# EasyEDA Pro project Foc驱动板.eprj, board PCB1
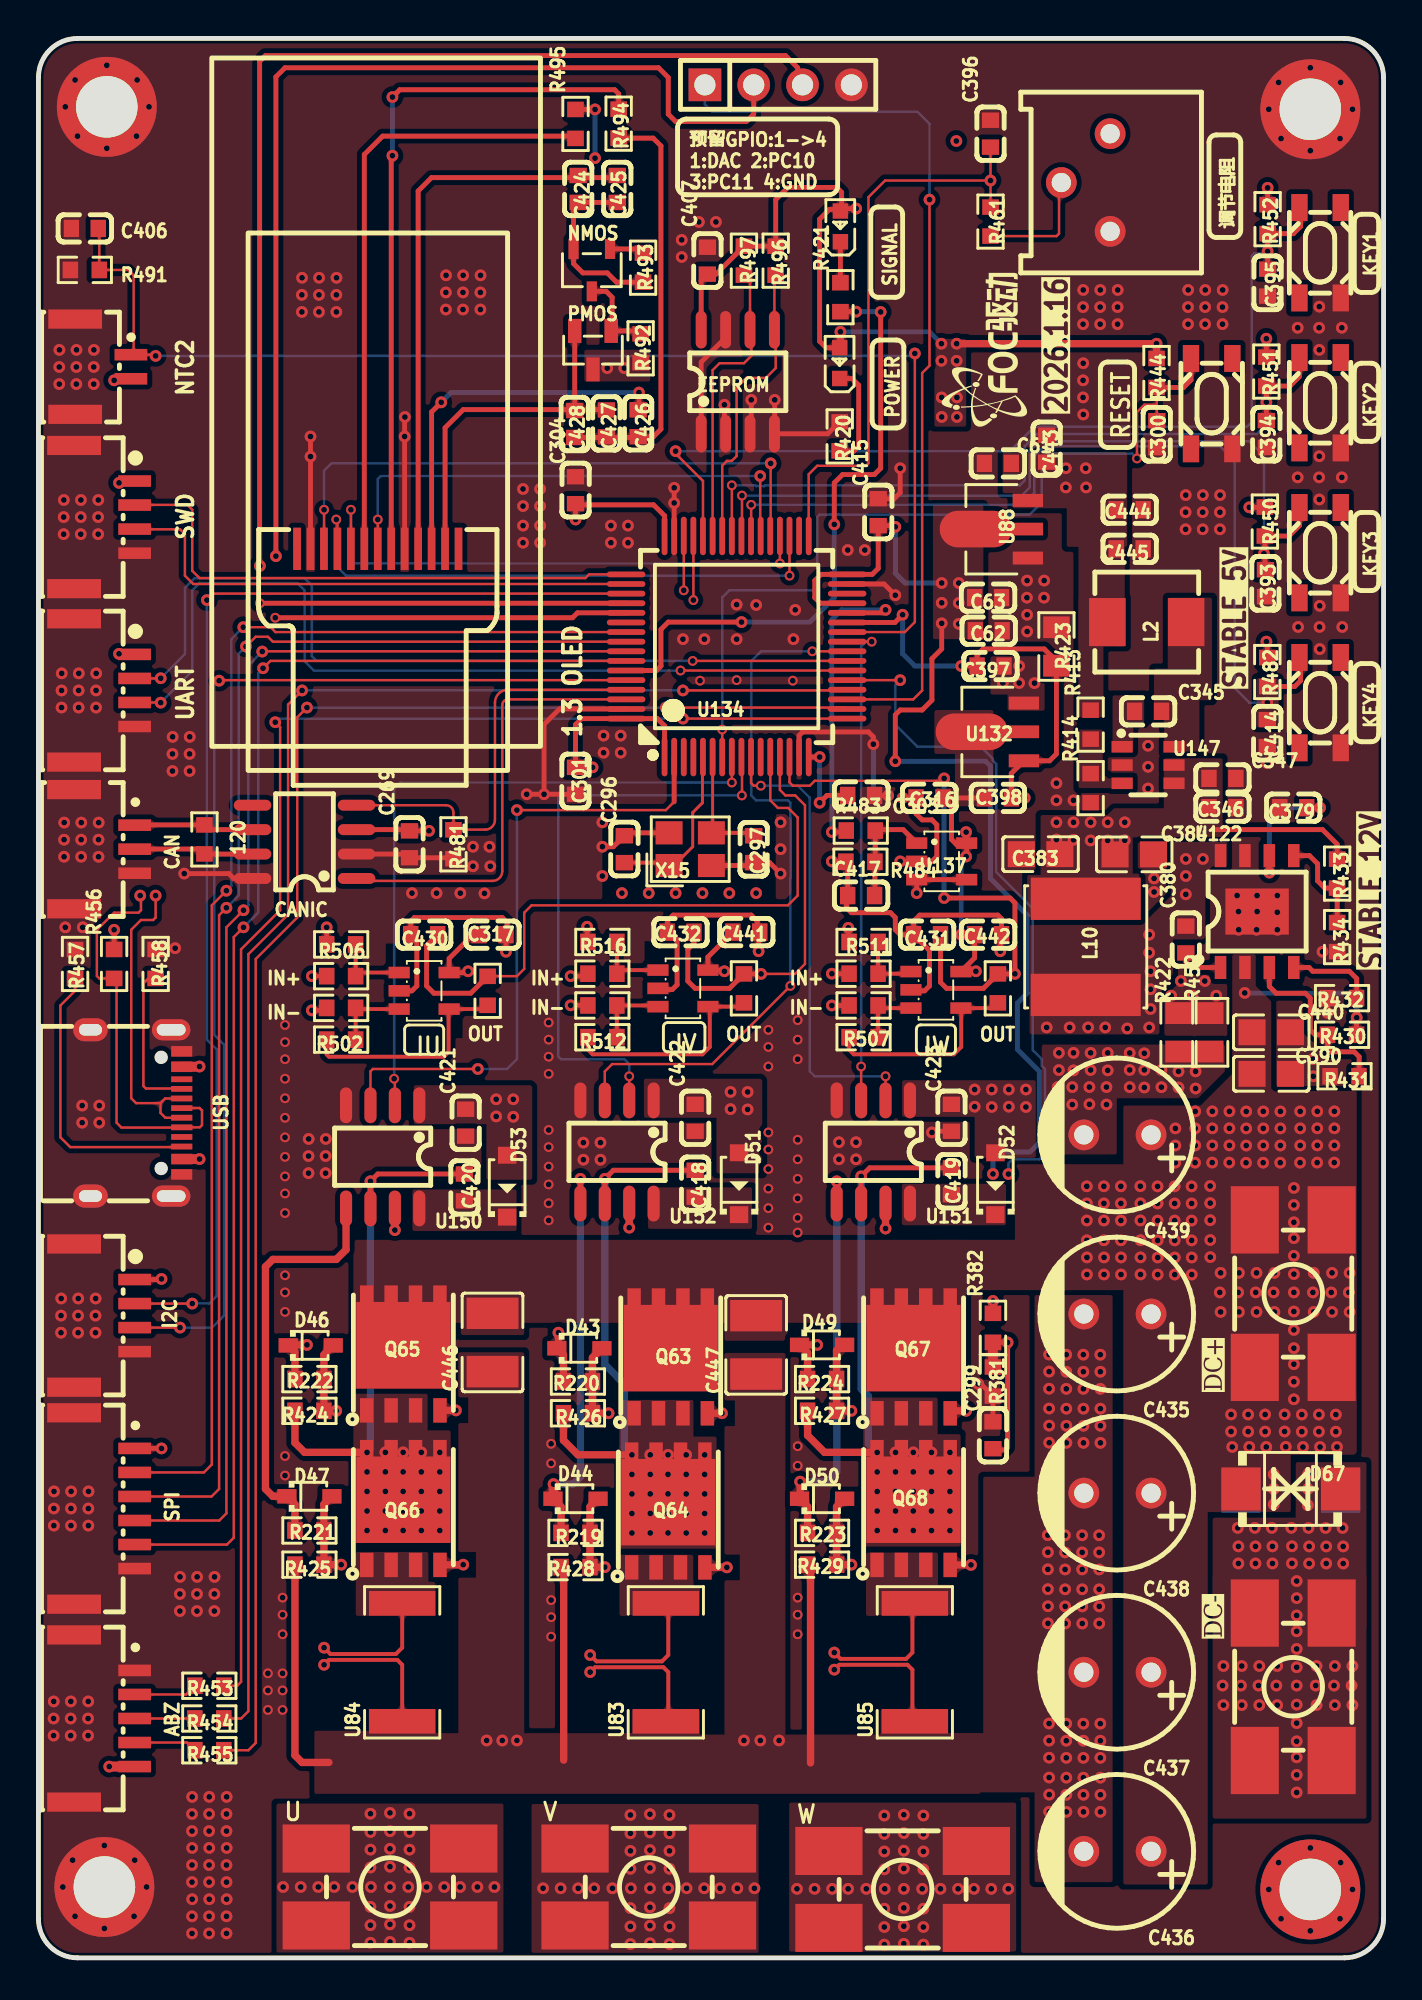
[diagram p8: board, top side]
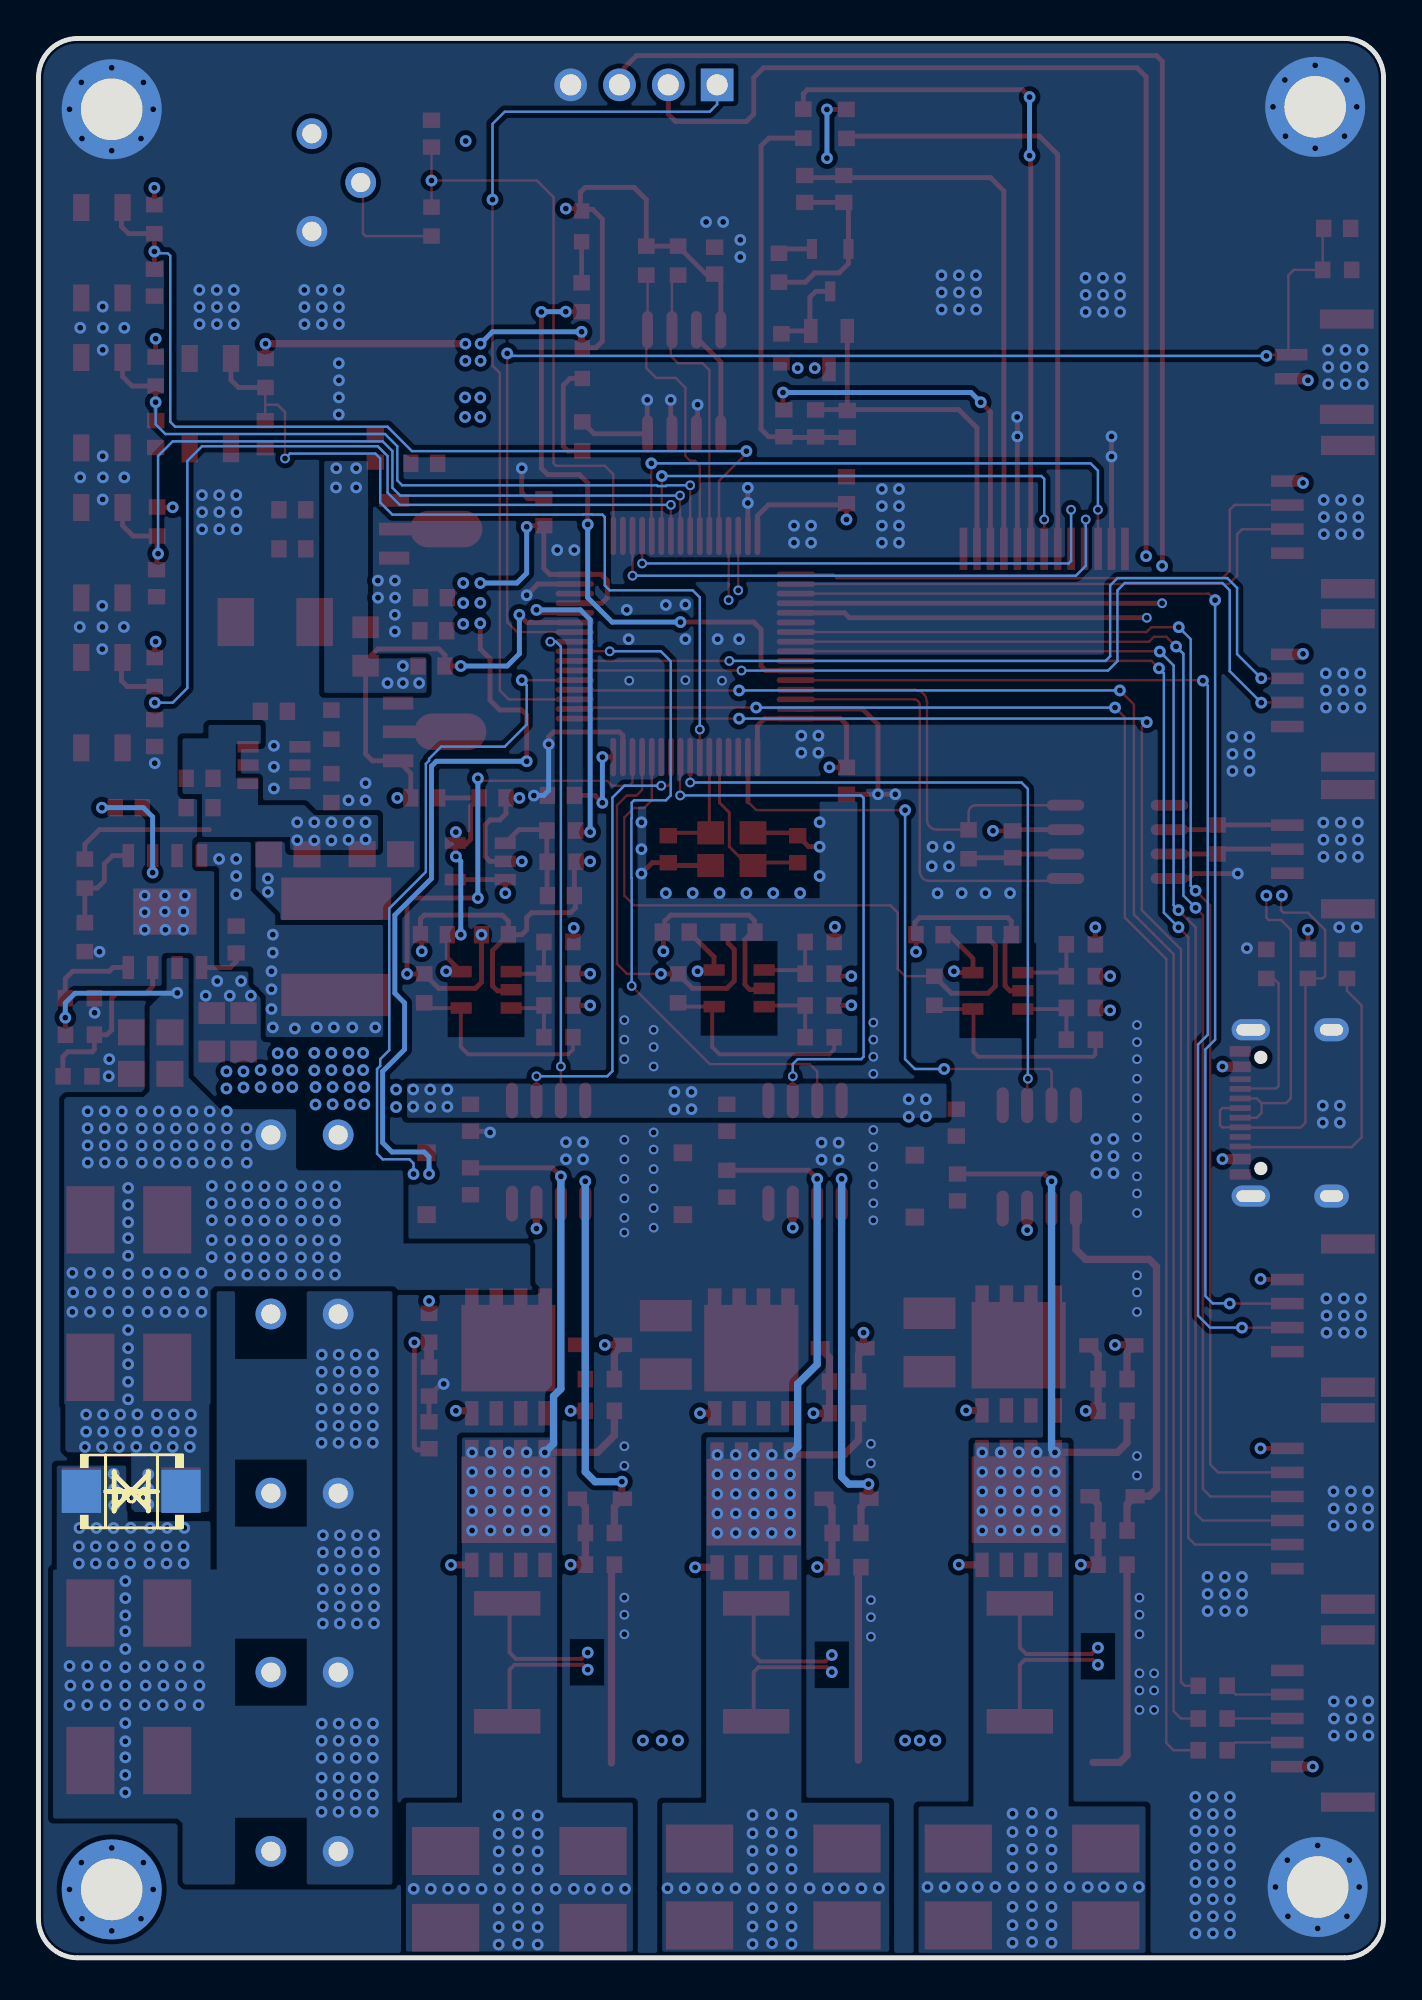
[diagram p9: board, bottom side, seen from below]

Outline 69.98 x 99.82 mm; copper layers: Top Layer, Inner1, Inner2, Bottom Layer. Coordinates in mm from the lower left corner of the outline.
Outline path: 0,97.79 0,2.03 arc(0.6,0.6) 2.03,0 67.94,0 arc(69.38,0.6) 69.98,2.03 69.98,97.79 arc(69.38,99.23) 67.94,99.82 2.03,99.82 arc(0.6,99.23) 0,97.79
Stack: Top Layer 0.035mm 外层铜厚1oz / Dielectric1 0.2104mm 7628 RC49% 8.6mil / Inner1 0.0152mm 内层铜厚 / Dielectric2 1.065mm 1.1mm H/HOZ Copper / Inner2 0.0152mm 内层铜厚 / Dielectric3 0.2104mm 7628 RC49% 8.6mil / Bottom Layer 0.035mm 外层铜厚1oz

## Design rules (mm)
template: 自定义配置
spacing copperThickness1oz (default): track to track 0.102, other pairs 0.152 to 0.3
spacing copperThickness2oz: track to track 0.203, other pairs 0.152 to 0.3
track width copperThickness1oz (default): min 0.127, default 0.254, max 2.54
track width copperThickness2oz: min 0.203, default 0.254, max 2.54
differential pair differentialPair (default): width min 0.127, default 0.254, max 2.54; gap min 0.152, default 0.152
via viaSize (default): diameter min 0.5, default 0.61, max 10; hole min 0.3, default 0.305, max 6.3

## Placement (name value [footprint] x y rotation side)
1.3 OLED  -  [OLED-SMD_ST7735S]  17.65 73.28 0 top
120  -  [R0603]  8.64 58.17 270 top
ABZ  -  [CONN-SMD_5P-P1.25_XUNPU_WAFER-GH1.25-5PWB]  3.43 12.45 270 top
C61  100nF  [C0603]  49.91 77.72 180 top
C62  10uF  [C0603]  49.44 69.02 0 top
C63  100nF  [C0603]  49.4 70.74 0 top
C269  100nF  [C0603]  19.3 57.91 270 top
C296  22pf  [C0603]  30.48 57.66 270 top
C297  22pf  [C0603]  37.21 57.66 90 top
C299  100nF  [C0603]  49.66 27.18 270 top
C300  100nF  [C0603]  58.18 79.24 90 top
C301  100nF  [C0603]  27.94 61.21 90 top
C303  100nF  [C0603]  42.8 60.45 180 top
C304  100nF  [C0603]  27.94 76.33 270 top
C316  100nF  [C0603]  46.35 60.33 0 top
C317  100nF  [C0603]  23.62 53.21 180 top
C345  100nF  [C0603]  57.73 64.83 180 top
C346  100nF  [C0603]  61.59 59.82 0 top
C347  22uF  [C0603]  61.59 61.34 180 top
C379  1uF  [C0603]  65.28 59.82 0 top
C380  100nF  [C0603]  59.69 52.96 270 top
C383  22uF  [C0805]  52.13 57.4 0 top
C384  22uF  [C0805]  57.01 57.39 180 top
C390  22uF  [C0805]  64.13 45.97 180 top
C393  100nF  [C0603]  63.83 71.49 90 top
C394  100nF  [C0603]  63.88 79.25 90 top
C395  100nF  [C0603]  63.95 87.12 90 top
C396  1nF  [C0603]  49.53 94.87 270 top
C397  100nF  [C0603]  49.53 67.18 180 top
C398  10uF  [C0603]  49.91 60.33 0 top
C406  100nF  [C0603]  2.41 89.94 0 top
C407  100nF  [C0603]  34.8 88.27 270 top
C414  100nF  [C0603]  63.93 63.7 90 top
C415  100nF  [C0603]  43.69 75.18 270 top
C417  10nF  [C0603]  42.8 55.24 0 top
C418  1uf  [C0603]  34.16 40.26 90 top
C419  1uf  [C0603]  47.5 40.39 90 top
C420  1uf  [C0603]  22.16 40.07 90 top
C421  4.7uF  [C0603]  22.22 43.43 270 top
C422  4.7uF  [C0603]  34.16 43.69 270 top
C423  4.7uF  [C0603]  47.5 43.69 270 top
C424  0.1uf  [C0603]  28.08 91.99 90 top
C425  4.7uf  [C0603]  30.11 91.99 90 top
C426  2.2uf  [C0603]  31.2 79.81 90 top
C427  4.7uf  [C0603]  29.55 79.8 90 top
C428  0.1uf  [C0603]  27.9 79.77 90 top
C430  1nF  [C0603]  20.07 53.21 0 top
C431  1nF  [C0603]  46.23 53.21 0 top
C432  1nF  [C0603]  33.4 53.34 0 top
C435  100uF  [CAP-TH_BD8.0-P3.50-D0.5-FD]  56.13 33.48 180 top
C436  100uF  [CAP-TH_BD8.0-P3.50-D0.5-FD]  56.13 5.54 180 top
C437  100uF  [CAP-TH_BD8.0-P3.50-D0.5-FD]  56.13 14.85 180 top
C438  100uF  [CAP-TH_BD8.0-P3.50-D0.5-FD]  56.13 24.17 180 top
C439  100uF  [CAP-TH_BD8.0-P3.50-D0.5-FD]  56.13 42.8 180 top
C440  4.7uF  [C0805]  64.13 48.13 180 top
C441  100nF  [C0603]  36.82 53.34 180 top
C442  100nF  [C0603]  49.4 53.21 180 top
C443  22uF  [C0603]  52.45 78.49 90 top
C444  22uF  [C0603]  56.77 75.31 0 top
C445  100nF  [C0603]  56.77 73.28 0 top
C446  100uF  [C1210]  23.62 32 90 top
C447  100uF  [C1210]  37.34 31.88 90 top
CAN  -  [CONN-TH_3P-P1.25_GH1.25]  3.43 57.66 270 top
CANIC  -  [SOIC-8_L5.0-W4.0-P1.27-LS6.0-BL]  13.84 58.04 90 top
D43  BAT43WS-7-F  [SOD-323_L1.8-W1.3-LS2.5-RD]  28.14 31.7 0 top
D44  BAT43WS-7-F  [SOD-323_L1.8-W1.3-LS2.5-RD]  27.94 23.88 0 top
D46  BAT43WS-7-F  [SOD-323_L1.8-W1.3-LS2.5-RD]  14.16 31.85 0 top
D47  BAT43WS-7-F  [SOD-323_L1.8-W1.3-LS2.5-RD]  14.1 24 0 top
D49  BAT43WS-7-F  [SOD-323_L1.8-W1.3-LS2.5-RD]  40.77 31.88 0 top
D50  BAT43WS-7-F  [SOD-323_L1.8-W1.3-LS2.5-RD]  40.77 23.88 0 top
D51  1N4148W  [SOD-123_L2.7-W1.6-LS3.7-FD]  36.45 40.26 270 top
D52  1N4148W  [SOD-123_L2.7-W1.6-LS3.7-FD]  49.78 40.26 270 top
D53  1N4148W  [SOD-123_L2.7-W1.6-LS3.7-FD]  24.38 40.13 270 top
D66  SMBJ48CA  [SMB_L4.6-W3.6-LS5.4-BI]  65.15 24.26 180 bottom
D67  SMBJ48CA  [SMB_L4.6-W3.6-LS5.4-BI]  65.15 24.38 180 top
DC+  -  [CONN-SMD_TS34031]  65.28 34.54 90 top
DC-  -  [CONN-SMD_TS34031]  65.28 14.1 90 top
EEPROM  -  [SOIC-8_L5.0-W4.0-P1.27-LS6.0-BL]  36.38 81.97 0 top
I2C  -  [CONN-SMD_4P-P1.25_XUNPU_WAFER-GH1.25-4PWB]  3.43 33.4 270 top
IN+  -  [R0603]  15.75 51.05 180 top
IN+#2  -  [R0603]  42.93 51.18 180 top
IN+#3  -  [R0603]  29.34 51.18 180 top
IN-  -  [R0603]  15.75 49.4 180 top
IN-#2  -  [R0603]  42.93 49.53 180 top
IN-#3  -  [R0603]  29.34 49.53 180 top
IU  -  [SOT-23-5_L3.0-W1.7-P0.95-LS2.8-BR]  20.07 50.29 180 top
IV  -  [SOT-23-5_L3.0-W1.7-P0.95-LS2.8-BR]  33.53 50.42 180 top
IW  -  [SOT-23-5_L3.0-W1.7-P0.95-LS2.8-BR]  46.69 50.34 180 top
KEY1  TS-1145A-B-A  [SW-SMD_4P-L4.2-W3.2-P2.15-LS5.2]  66.67 88.68 180 top
KEY2  TS-1145A-B-A  [SW-SMD_4P-L4.2-W3.2-P2.15-LS5.2]  66.67 80.88 180 top
KEY3  TS-1145A-B-A  [SW-SMD_4P-L4.2-W3.2-P2.15-LS5.2]  66.67 73.08 180 top
KEY4  TS-1145A-B-A  [SW-SMD_4P-L4.2-W3.2-P2.15-LS5.2]  66.67 65.28 180 top
L2  10uH  [IND-SMD_L5.4-W5.2_FXL0530]  57.66 69.47 180 top
L10  18uH  [IND-SMD_L6.0-W6.0]  54.48 52.58 90 top
NMOS  -  [SOT-23-3_L3.0-W1.7-P0.95-LS2.9-BR]  28.79 87.77 90 top
NOREF  -  [Pad_e217]  3.56 96.27 0 top
NOREF#2  -  [Pad_e226]  3.43 3.68 0 top
NOREF#3  -  [Pad_e207]  66.17 96.14 0 top
NOREF#4  -  [Pad_e235]  66.17 3.56 0 top
NTC2  -  [CONN-TH_2P-P1.25_XUNPU_WAFER-GH1.25-2PWB]  3.36 82.75 270 top
OUT  -  [R0603]  23.37 50.29 270 top
OUT#2  -  [R0603]  49.91 50.42 270 top
OUT#3  -  [R0603]  36.7 50.42 270 top
PMOS  -  [SOT-23-3_L2.9-W1.3-P1.90-LS2.4-BR]  28.85 83.61 90 top
POWER  -  [LED0603-RD]  41.68 82.94 90 top
Q63  CSD18540Q5B  [VSON-CLIP-8_L5.0-W6.0-P1.27-BL]  32.89 31.32 0 top
Q64  CSD18540Q5B  [VSON-CLIP-8_L5.0-W6.0-P1.27-BL]  32.77 23.31 0 top
Q65  CSD18540Q5B  [VSON-CLIP-8_L5.0-W6.0-P1.27-BL]  18.98 31.47 0 top
Q66  CSD18540Q5B  [VSON-CLIP-8_L5.0-W6.0-P1.27-BL]  18.98 23.44 0 top
Q67  CSD18540Q5B  [VSON-CLIP-8_L5.0-W6.0-P1.27-BL]  45.53 31.32 0 top
Q68  CSD18540Q5B  [VSON-CLIP-8_L5.0-W6.0-P1.27-BL]  45.53 23.43 0 top
R219  10Ω  [R0603]  27.94 22.1 0 top
R220  10Ω  [R0603]  28.07 29.97 0 top
R221  10Ω  [R0603]  14.1 22.22 0 top
R222  10Ω  [R0603]  14.1 30.1 0 top
R223  10Ω  [R0603]  40.77 22.1 0 top
R224  10Ω  [R0603]  40.77 30.1 0 top
R381  KNTC0603/10KF3950  [R0603]  49.66 29.97 90 top
R382  10kΩ  [R0603]  49.66 32.77 270 top
R413  56KΩ  [R0603]  54.74 64.13 270 top
R414  7.5KΩ  [R0603]  54.74 60.83 270 top
R420  1kΩ  [R0603]  41.68 79.13 90 top
R421  1kΩ  [R0603]  41.72 86.37 270 top
R422  0Ω  [R0805]  59.31 48.13 270 top
R423  0Ω  [R0805]  52.96 68.2 90 top
R424  10kΩ  [R0603]  14.1 28.45 0 top
R425  10kΩ  [R0603]  14.1 20.45 0 top
R426  10kΩ  [R0603]  28.07 28.32 0 top
R427  10kΩ  [R0603]  40.77 28.45 0 top
R428  10kΩ  [R0603]  27.94 20.32 0 top
R429  10kΩ  [R0603]  40.77 20.45 0 top
R430  10KΩ  [R0603]  67.82 48.01 0 top
R431  1kΩ  [R0603]  67.94 45.85 0 top
R432  64.9KΩ  [R0603]  67.82 49.91 0 top
R433  100kΩ  [R0603]  67.56 56.39 90 top
R434  10kΩ  [R0603]  67.56 53.09 90 top
R444  10KΩ  [R0603]  58.17 82.42 90 top
R450  10KΩ  [R0603]  63.8 74.7 90 top
R451  10KΩ  [R0603]  63.88 82.5 90 top
R452  10KΩ  [R0603]  63.95 90.42 90 top
R453  1kΩ  [R0603]  8.89 14.15 0 top
R454  1kΩ  [R0603]  8.89 12.45 0 top
R455  1kΩ  [R0603]  8.89 10.79 0 top
R456  1.5kΩ  [R0603]  3.94 51.69 270 top
R457  5.1kΩ  [R0603]  1.91 51.69 90 top
R458  5.1kΩ  [R0603]  6.1 51.69 90 top
R459  0Ω  [R0805]  60.96 48.13 270 top
R461  10kΩ  [R0603]  49.53 90.3 90 top
R481  10KΩ  [R0603]  21.59 57.91 90 top
R482  10KΩ  [R0603]  63.93 66.87 90 top
R483  10kΩ  [R0603]  42.78 58.63 0 top
R484  10kΩ  [R0603]  42.76 57 180 top
R491  10kΩ  [R0603]  2.41 87.78 180 top
R492  47kΩ  [R0603]  31.33 83.71 90 top
R493  47kΩ  [R0603]  31.45 87.9 90 top
R494  560kΩ  [R0603]  30.19 95.39 90 top
R495  10kΩ  [R0603]  27.94 95.38 270 top
R496  1kΩ  [R0603]  38.35 88.27 90 top
R497  1kΩ  [R0603]  36.7 88.27 90 top
R502  20kΩ  [R0603]  15.75 47.75 0 top
R506  20kΩ  [R0603]  15.75 52.7 0 top
R507  20kΩ  [R0603]  42.93 47.88 0 top
R511  20kΩ  [R0603]  42.93 52.83 0 top
R512  20kΩ  [R0603]  29.34 47.88 0 top
R516  20kΩ  [R0603]  29.34 52.83 0 top
RESET>  -  [SW-SMD_4P-L4.2-W3.2-P2.15-LS5.2]  61.04 80.83 180 top
SIGNAL  -  [LED0603-RD]  41.72 90.05 90 top
SPI  -  [CONN-SMD_6P-P1.25_XUNPU_WAFER-GH1.25-6PWB]  3.43 23.37 270 top
SWD  -  [CONN-SMD_4P-P1.25_XUNPU_WAFER-GH1.25-4PWB]  3.43 74.93 270 top
U  -  [CONN-SMD_TS34031]  18.29 3.68 0 top
U83  5mΩ  [R2512]  32.64 15.37 90 top
U84  5mΩ  [R2512]  18.92 15.37 90 top
U85  5mΩ  [R2512]  45.59 15.37 90 top
U88  AMS1117-3.3  [SOT-89_L4.5-W2.5-P1.50-LS4.2-BR]  50.12 74.3 0 top
U122  LGS54360  [ESOP-8_L4.9-W3.9-P1.27-LS6.0-BL-EP]  63.4 54.41 0 top
U132  AMS1117-3.3  [SOT-89_L4.5-W2.5-P1.50-LS4.2-BR]  49.91 63.75 0 top
U134  STM32G431RBT6  [LQFP-64_L10.0-W10.0-P0.50-LS12.0-BL]  36.32 68.2 0 top
U137  LM321MFX/NOPB  [SOT-23-5_L3.0-W1.7-P0.95-LS2.8-BR]  46.99 57.02 180 top
U147  LGS5116B  [SOT-23-6_L2.9-W1.6-P0.95-LS2.8-BR]  57.73 62.03 180 top
U150  EG2132  [SOP-8_L4.9-W3.9-P1.27-LS6.0-BL]  17.91 41.66 180 top
U151  EG2132  [SOP-8_L4.9-W3.9-P1.27-LS6.0-BL]  43.43 41.91 180 top
U152  EG2132  [SOP-8_L4.9-W3.9-P1.27-LS6.0-BL]  30.1 41.91 180 top
UART  -  [CONN-SMD_4P-P1.25_XUNPU_WAFER-GH1.25-4PWB]  3.43 65.91 270 top
USB  -  [USB-C-SMD_TYPE-C-6PIN-2MD-073]  5.08 43.94 270 top
V  -  [CONN-SMD_TS34031]  31.75 3.68 0 top
W  -  [CONN-SMD_TS34031]  44.96 3.56 0 top
X15  8MHz  [CRYSTAL-SMD_4P-L3.2-W2.5-BL]  33.91 57.66 0 top
调节电阻  -  [RES-ADJ-TH_3P-L9.5-W9.5-P2.54-BR-BS]  54.48 92.33 0 top
预留GPIO:1->4
1:DAC 2:PC10
3:PC11 4:GND  -  [HDR-TH_4P-P2.54-V-M]  38.48 97.41 0 top

## Footprints (pads in the part's own frame, mm; a bottom-side part is the same pattern mirrored in y, then rotated)
C0603
  rect 0.8x0.9 smd: 1(-0.7,0) 2(0.7,0)
C0805
  rect 1.41x1.35 smd: 1(-1,0) 2(1,0)
C1210
  rect 1.635x2.7 smd: 1(-1.518,0) 2(1.518,0)
CAP-TH_BD8.0-P3.50-D0.5-FD
  round 1.6 hole 1: 1(-1.75,0) 2(1.75,0)
CONN-SMD_4P-P1.25_XUNPU_WAFER-GH1.25-4PWB
  rect 0.6x1.7 smd: 1(-1.875,1.575) 2(-0.625,1.575) 3(0.625,1.575) 4(1.875,1.575)
  rect 1x2.8 smd: 5(3.725,-1.575) 6(-3.725,-1.575)
CONN-SMD_5P-P1.25_XUNPU_WAFER-GH1.25-5PWB
  rect 0.6x1.7 smd: 1(-2.5,1.575) 2(-1.25,1.575) 3(-0.001,1.575) 4(1.25,1.575) 5(2.5,1.575)
  rect 1x2.8 smd: 6(4.35,-1.575) 7(-4.35,-1.575)
CONN-SMD_6P-P1.25_XUNPU_WAFER-GH1.25-6PWB
  rect 0.6x1.7 smd: 1(-3.125,1.575) 2(-1.875,1.575) 3(-0.625,1.575) 4(0.625,1.575) 5(1.875,1.575) 6(3.125,1.575)
  rect 1x2.8 smd: 7(4.975,-1.575) 8(-4.975,-1.575)
CONN-SMD_TS34031
  rect 3.5x2.5 smd: 1(-3.835,2) 2(-3.835,-2) 3(3.835,-2) 4(3.835,2)
CONN-TH_2P-P1.25_XUNPU_WAFER-GH1.25-2PWB
  rect 0.6x1.7 smd: 1(-0.625,1.45) 2(0.625,1.45)
  rect 1x2.8 smd: 3(-2.475,-1.45) 4(2.475,-1.45)
CONN-TH_3P-P1.25_GH1.25
  rect 0.6x1.7 smd: 1(-1.25,1.575) 2(0,1.575) 3(1.25,1.575)
  rect 1x2.8 smd: 4(3.1,-1.575) 5(-3.1,-1.575)
CRYSTAL-SMD_4P-L3.2-W2.5-BL
  rect 1.4x1.2 smd: 1(-1.1,-0.85) 2(1.1,-0.85) 3(1.1,0.85) 4(-1.1,0.85)
ESOP-8_L4.9-W3.9-P1.27-LS6.0-BL-EP
  rect 0.6x1.2 smd: 1(-1.905,-2.909) 2(-0.635,-2.909) 3(0.635,-2.909) 4(1.905,-2.909) 5(1.905,2.909) 6(0.635,2.909) 7(-0.635,2.909) 8(-1.905,2.909)
  rect 3.3x2.4 smd: 9(0,0)
HDR-TH_4P-P2.54-V-M
  rect 1.7x1.7 hole 1.1: 1(-3.81,0)
  round 1.7 hole 1.1: 2(-1.27,0) 3(1.27,0) 4(3.81,0)
IND-SMD_L5.4-W5.2_FXL0530
  rect 1.9x2.5 smd: 1(-2.05,0) 2(2.05,0)
IND-SMD_L6.0-W6.0
  rect 2.2x5.72 smd: 1(-2.5,0) 2(2.5,0)
LED0603-RD
  rect 0.8x0.8 smd: 1(-0.799,0) 2(0.799,0)
LQFP-64_L10.0-W10.0-P0.50-LS12.0-BL
  oval 0.3x2 smd: 1(-3.75,-5.75) 2(-3.25,-5.75) 3(-2.75,-5.75) 4(-2.25,-5.75) 5(-1.75,-5.75) 6(-1.25,-5.75) 7(-0.75,-5.75) 8(-0.25,-5.75) 9(0.25,-5.75) 10(0.75,-5.75) 11(1.25,-5.75) 12(1.75,-5.75) 13(2.25,-5.75) 14(2.75,-5.75) 15(3.25,-5.75) 16(3.75,-5.75) 33(3.75,5.75) 34(3.25,5.75) 35(2.75,5.75) 36(2.25,5.75) 37(1.75,5.75) 38(1.25,5.75) 39(0.75,5.75) 40(0.25,5.75) 41(-0.25,5.75) 42(-0.75,5.75) 43(-1.25,5.75) 44(-1.75,5.75) 45(-2.25,5.75) 46(-2.75,5.75) 47(-3.25,5.75) 48(-3.75,5.75)
  oval 2x0.3 smd: 17(5.75,-3.75) 18(5.75,-3.25) 19(5.75,-2.75) 20(5.75,-2.25) 21(5.75,-1.75) 22(5.75,-1.25) 23(5.75,-0.75) 24(5.75,-0.25) 25(5.75,0.25) 26(5.75,0.75) 27(5.75,1.25) 28(5.75,1.75) 29(5.75,2.25) 30(5.75,2.75) 31(5.75,3.25) 32(5.75,3.75) 49(-5.75,3.75) 50(-5.75,3.25) 51(-5.75,2.75) 52(-5.75,2.25) 53(-5.75,1.75) 54(-5.75,1.25) 55(-5.75,0.75) 56(-5.75,0.25) 57(-5.75,-0.25) 58(-5.75,-0.75) 59(-5.75,-1.25) 60(-5.75,-1.75) 61(-5.75,-2.25) 62(-5.75,-2.75) 63(-5.75,-3.25) 64(-5.75,-3.75)
OLED-SMD_ST7735S
  rect 0.4x2.2 smd: 1(4.2,0) 2(3.5,0) 3(2.8,0) 4(2.1,0) 5(1.4,0) 6(0.7,0) 7(0,0) 8(-0.7,0) 9(-1.4,0) 10(-2.1,0) 11(-2.8,0) 12(-3.5,0) 13(-4.2,0)
Pad_e207
  round 5.2 hole 3.2: 1(0,0)
Pad_e217
  round 5.2 hole 3.2: 1(0,0)
Pad_e226
  round 5.2 hole 3.2: 1(0,0)
Pad_e235
  round 5.2 hole 3.2: 1(0,0)
R0603
  rect 0.806x0.864 smd: 1(-0.753,0) 2(0.753,0)
R0805
  rect 1.133x1.377 smd: 1(-1,0) 2(1,0)
R2512
  rect 1.282x3.456 smd: 1(-3.067,0) 2(3.067,0)
RES-ADJ-TH_3P-L9.5-W9.5-P2.54-BR-BS
  round 1.6 hole 1: 1(1.27,-2.54) 2(-1.27,0) 3(1.27,2.54)
SMB_L4.6-W3.6-LS5.4-BI
  rect 2.047x2.241 smd: 1(-2.591,0) 2(2.591,0)
SOD-123_L2.7-W1.6-LS3.7-FD
  rect 0.88x0.96 smd: 1(-1.61,0) 2(1.61,0)
SOD-323_L1.8-W1.3-LS2.5-RD
  rect 1x0.75 smd: 1(-1.173,0) 2(1.173,0)
SOIC-8_L5.0-W4.0-P1.27-LS6.0-BL
  oval 0.569x1.95 smd: 1(-1.905,-2.705) 2(-0.635,-2.705) 3(0.635,-2.705) 4(1.905,-2.705) 5(1.905,2.705) 6(0.635,2.705) 7(-0.635,2.705) 8(-1.905,2.705)
SOP-8_L4.9-W3.9-P1.27-LS6.0-BL
  oval 0.63x1.865 smd: 1(-1.905,-2.683) 2(-0.635,-2.683) 3(0.635,-2.683) 4(1.905,-2.683) 5(1.905,2.683) 6(0.635,2.683) 7(-0.635,2.683) 8(-1.905,2.683)
SOT-23-3_L2.9-W1.3-P1.90-LS2.4-BR
  rect 1.25x0.7 smd: 1(1,-0.95) 2(1,0.95) 3(-1,0)
SOT-23-3_L3.0-W1.7-P0.95-LS2.9-BR
  rect 1.038x0.532 smd: 1(1.101,-0.95) 2(1.101,0.95) 3(-1.101,0)
SOT-23-5_L3.0-W1.7-P0.95-LS2.8-BR
  rect 1.1x0.6 smd: 1(1.3,-0.95) 2(1.3,0) 3(1.3,0.95) 4(-1.3,0.95) 5(-1.3,-0.95)
SOT-23-6_L2.9-W1.6-P0.95-LS2.8-BR
  rect 1.1x0.6 smd: 1(1.35,-0.95) 2(1.35,0) 3(1.35,0.95) 4(-1.35,0.95) 5(-1.35,0) 6(-1.35,-0.95)
SOT-89_L4.5-W2.5-P1.50-LS4.2-BR
  rect 1.575x0.672 smd: 1(1.356,-1.5) 3(1.356,1.5)
  custom 0x0 smd: 2(-1.356,0.009)
SW-SMD_4P-L4.2-W3.2-P2.15-LS5.2
  rect 0.85x1.4 smd: 1(1.075,2.35) 2(1.075,-2.35) 3(-1.075,2.35) 4(-1.075,-2.35)
USB-C-SMD_TYPE-C-6PIN-2MD-073
  rect 0.55x1.1 smd: 1(-3.2,2.375) 2(-2.4,2.375) 11(2.4,2.375) 12(3.2,2.375)
  rect 0.3x1.1 smd: 3(-1.75,2.375) 4(-1.25,2.375) 5(-0.75,2.375) 6(-0.25,2.375) 7(0.25,2.375) 8(0.75,2.375) 9(1.25,2.375) 10(1.75,2.375)
  oval 1.1x2 hole 0.6x1.5: 13(-4.325,1.825) 14(4.325,1.825)
  oval 1.2x1.8 hole 0.6x1.2: 13(-4.325,-2.375) 14(4.325,-2.375)
VSON-CLIP-8_L5.0-W6.0-P1.27-BL
  rect 0.7x1.27 smd: 1(-1.904,-3) 2(-0.636,-3) 3(0.636,-3) 4(1.906,-3)
  rect 0.7x1 smd: 5(1.904,3) 6(0.634,3) 7(-0.636,3) 8(-1.906,3)
  rect 4.9x4.5 smd: 8(-0.001,0.39)

## Nets
3.3V: ABZ.5 C62.1 C63.1 C301.2 C303.2 C304.2 C407.2 C415.2 EEPROM.8 I2C.1 NTC2.2 POWER.2 R382.1 R444.2 R450.2 R451.2 R452.2 R456.1 R482.2 R495.1 R496.2 R497.2 SIGNAL.2 SPI.1 SWD.1 U88.2 U134.1 U134.16 U134.29 U134.32 U134.48 U134.64 UART.1 调节电阻.3
5V: C61.1 C269.1 C397.1 C443.1 C444.1 C445.1 CANIC.3 L2.2 PMOS.3 R413.1 R492.1 U88.3 U132.3 USB.2 USB.11
12V: C346.1 C347.2 C383.2 C384.2 C421.1 C422.1 C423.1 D51.1 D52.1 D53.1 L10.2 R433.2 U147.4 U147.5 U150.1 U151.1 U152.1
A3.3V: C316.2 C317.2 C398.1 C441.2 C442.2 IU.5 IV.5 IW.5 R483.1 U132.2 U134.28 U137.5
AGND: C316.1 C317.1 C397.2 C398.2 C417.1 C430.1 C431.1 C432.1 C441.1 C442.1 IU.2 IV.2 IW.2 R423.1 R484.2 U132.1 U134.27 U137.2
GND: 1.3 OLED.5 1.3 OLED.12 ABZ.1 ABZ.6 ABZ.7 C61.2 C62.2 C63.2 C269.2 C296.1 C297.1 C299.1 C300.1 C301.1 C303.1 C304.1 C346.2 C347.1 C379.1 C383.1 C384.1 C390.1 C393.1 C394.1 C395.1 C396.1 C406.1 C407.1 C414.1 C415.1 C421.2 C422.2 C423.2 C440.1 C443.2 C444.2 C445.2 CAN.3 CAN.4 CAN.5 CANIC.2 CANIC.8 EEPROM.1 EEPROM.2 EEPROM.3 EEPROM.4 EEPROM.7 I2C.4 I2C.5 I2C.6 KEY1.3 KEY2.3 KEY3.3 KEY4.3 NOREF.1 NOREF#2.1 NOREF#3.1 NTC2.3 NTC2.4 R381.1 R414.2 R420.2 R422.1 R423.2 R431.1 R432.1 R434.1 R457.2 R458.2 R459.1 R481.1 R491.2 RESET>.3 SPI.6 SPI.7 SPI.8 SWD.4 SWD.5 SWD.6 U88.1 U122.7 U122.9 U134.15 U134.31 U134.47 U134.63 U147.2 U150.4 U151.4 U152.4 UART.4 UART.5 UART.6 USB.1 USB.12 USB.13 USB.14 X15.2 X15.4 调节电阻.1 预留GPIO:1->4
1:DAC 2:PC10
3:PC11 4:GND.4
PGND: C435.2 C436.2 C437.2 C438.2 C439.2 C446.1 C447.1 D66.1 D67.1 DC-.1 DC-.2 DC-.3 DC-.4 IN+.2 IN+#2.2 IN+#3.2 NOREF#4.1 R422.2 R425.1 R428.1 R429.1 R459.2 U83.1 U84.1 U85.1
VBUS: C390.2 C435.1 C436.1 C437.1 C438.1 C439.1 C440.2 C446.2 C447.2 D66.2 D67.2 DC+.1 DC+.2 DC+.3 DC+.4 Q63.5 Q63.6 Q63.7 Q63.8 Q65.5 Q65.6 Q65.7 Q65.8 Q67.5 Q67.6 Q67.7 Q67.8 R430.2 U122.2
VDD: 1.3 OLED.4 C424.2 C425.2
ADC_IN: C396.2 R461.2 U134.33
BUTTON1: C395.2 KEY1.2 R452.1 U134.44
BUTTON2: C394.2 KEY2.2 R451.1 U134.41
BUTTON3: C393.2 KEY3.2 R450.1 U134.40
BUTTON4: C414.2 KEY4.2 R482.1 U134.39
CAN_H: 120.1 CAN.1 CANIC.6
CAN_L: 120.2 CAN.2 CANIC.7
DAC_OUT: U134.19 预留GPIO:1->4
1:DAC 2:PC10
3:PC11 4:GND.1
EEP_SCL: EEPROM.6 R497.1 U134.43
EEP_SDA: EEPROM.5 R496.1 U134.42
FB: R433.1 R434.2 U122.5
FDCAN_RX: CANIC.4 R481.2 U134.61
FDCAN_TX: CANIC.1 U134.62
GPIO1: U134.52 预留GPIO:1->4
1:DAC 2:PC10
3:PC11 4:GND.3
GPIO2: U134.53 预留GPIO:1->4
1:DAC 2:PC10
3:PC11 4:GND.2
HA: R455.2 U134.18
HB: R454.2 U134.20
HO1: D46.1 R222.1 U150.7
HO2: D43.1 R220.1 U152.7
HO3: D49.1 R224.1 U151.7
HZ: R453.2 U134.17
I2C1_SCL: I2C.2 U134.51
I2C1_SDA: I2C.3 U134.60
IBUS: U134.11
IREF: 1.3 OLED.6 R494.2
IU: C430.2 OUT.1 U134.12
IV: C432.2 OUT#3.1 U134.13
IW: C431.2 OUT#2.1 U134.14
LED: R421.2 U134.59
LO1: D47.1 R221.1 U150.5
LO2: D44.1 R219.1 U152.5
LO3: D50.1 R223.1 U151.5
NRST: C300.2 R444.1 RESET>.2 U134.7
NTC1: C299.2 R381.2 R382.2 U134.21
NTC2: C406.2 NTC2.1 R491.1 U134.26
OLED_CS: 1.3 OLED.7 U134.38
OLED_DC: 1.3 OLED.9 U134.36
OLED_GPIO: NMOS.1 R493.2
OLED_RES: 1.3 OLED.8 R495.2
OLED_SCK: 1.3 OLED.10 U134.35
OLED_SDA: 1.3 OLED.11 U134.37
OSC_IN: C296.2 U134.5 X15.1
OSC_OUT: C297.2 U134.6 X15.3
PWM1: U134.8 U150.2
PWM1N: U134.2 U150.3
PWM2: U134.9 U152.2
PWM2N: U134.24 U152.3
PWM3: U134.10 U151.2
PWM3N: U134.25 U151.3
SPI_CS: SPI.2 U134.55
SPI_MISO: SPI.4 U134.57
SPI_MOSI: SPI.5 U134.58
SPI_SCK: SPI.3 U134.56
SWCLK: SWD.3 U134.50
SWDIO: SWD.2 U134.49
U: C420.2 Q65.1 Q65.2 Q65.3 Q66.5 Q66.6 Q66.7 Q66.8 R424.1 U.1 U.2 U.3 U.4 U150.6
U_INP: IN-.2 Q66.1 Q66.2 Q66.3 U84.2
USART_RX: U134.23 UART.2
USART_TX: U134.22 UART.3
USB_DM: U134.45 USB.5 USB.7
USB_DP: R456.2 U134.46 USB.6 USB.8
V: C418.2 Q63.1 Q63.2 Q63.3 Q64.5 Q64.6 Q64.7 Q64.8 R426.1 U152.6 V.1 V.2 V.3 V.4
V_INP: IN-#3.2 Q64.1 Q64.2 Q64.3 U83.2
VB1: C420.1 D53.2 U150.8
VB2: C418.1 D51.2 U152.8
VB3: C419.1 D52.2 U151.8
VCOM: 1.3 OLED.3 C426.2
VPP: 1.3 OLED.2 C427.2 C428.2 PMOS.2
VREF: R506.1 R511.1 R516.1 U137.3 U137.4
VS3: C419.2 Q67.1 Q67.2 Q67.3 Q68.5 Q68.6 Q68.7 Q68.8 R427.1 U151.6 W.1 W.2 W.3 W.4
W_INP: IN-#2.2 Q68.1 Q68.2 Q68.3 U85.2
$1N9085: C345.2 U147.1
$1N9140: POWER.1 R420.1
$1N9141: R421.1 SIGNAL.1
$1N9145: C380.1 L10.1 U122.8
$1N9147: C379.2 U122.6
$1N9157: R430.1 R431.2 U122.3
$1N9158: R432.2 U122.4
$1N9186: R457.1 USB.10
$1N9188: R458.1 USB.4
$1N9190: R461.1 调节电阻.2
$1N9204: ABZ.2 R453.1
$1N9205: ABZ.3 R454.1